# EAGLE schematic Resistor_Resistor (EAGLE 8.3.0), part 29 of 43
## Nets (continued)
N$2: R201.2 R202.2 R203.2 R204.2 R205.2 R206.2 R207.2 R208.2 R209.2 R210.2 R211.2 R212.2 R213.2 R214.2 R215.2 R216.2 R217.2 R218.2 R219.2 R220.2 R221.2 R222.2 R223.2 R224.2 R225.2 R226.2 R227.2 R228.2 R229.2 R230.2 R231.2 R232.2 R233.2 R234.2 R235.2 R236.2 R237.2 R238.2 R239.2 R240.2 R241.2 R242.2 R243.2 R244.2 R245.2 R246.2 R247.2 R248.2 R249.2 R250.2 R251.2 R252.2 R253.2 R254.2 R255.2 R256.2 R257.2 R258.2 R259.2 R260.2 R261.2 R262.2 R263.2 R264.2 R265.2 R266.2 R267.2 R268.2 R269.2 R270.2 R271.2 R272.2 R273.2 R274.2 R275.2 R276.2 R277.2 R278.2 R279.2 R280.2 R281.2 R282.2 R283.2 R284.2 R285.2 R286.2 R287.2 R288.2 R289.2 R290.2 R291.2 R292.2 R293.2 R294.2 R295.2 R296.2 R297.2 R298.2 R299.2 R300.2 R301.2 R302.2 R303.2 R304.2 R305.2 R306.2 R307.2 R308.2 R309.2 R310.2 R311.2 R312.2 R313.2 R314.2 R315.2 R316.2 R317.2 R318.2 R319.2 R320.2 R321.2 R322.2 R323.2 R324.2 R325.2 R326.2 R327.2 R328.2 R329.2 R330.2 R331.2 R332.2 R333.2 R334.2 R335.2 R336.2 R337.2 R338.2 R339.2 R340.2 R341.2 R342.2 R343.2 R344.2 R345.2 R346.2 R347.2 R348.2 R349.2 R350.2 R351.2 R352.2 R353.2 R354.2 R355.2 R356.2 R357.2 R358.2 R359.2 R360.2 R361.2 R362.2 R363.2 R364.2 R365.2 R366.2 R367.2 R368.2 R369.2 R370.2 R371.2 R372.2 R373.2 R374.2 R375.2 R376.2 R377.2 R378.2 R379.2 R380.2 R381.2 R382.2 R383.2 R384.2 R385.2 R386.2 R387.2 R388.2 R389.2 R390.2 R391.2 R392.2 R393.2 R394.2 R395.2 R396.2 R397.2 R398.2 R399.2 R400.2 R401.1 R402.1 R403.1 R404.1 R405.1 R406.1 R407.1 R408.1 R409.1 R410.1 R411.1 R412.1 R413.1 R414.1 R415.1 R416.1 R417.1 R418.1 R419.1 R420.1 R421.1 R422.1 R423.1 R424.1 R425.1 R426.1 R427.1 R428.1 R429.1 R430.1 R431.1 R432.1 R433.1 R434.1 R435.1 R436.1 R437.1 R438.1 R439.1 R440.1 R441.1 R442.1 R443.1 R444.1 R445.1 R446.1 R447.1 R448.1 R449.1 R450.1 R451.1 R452.1 R453.1 R454.1 R455.1 R456.1 R457.1 R458.1 R459.1 R460.1 R461.1 R462.1 R463.1 R464.1 R465.1 R466.1 R467.1 R468.1 R469.1 R470.1 R471.1 R472.1 R473.1 R474.1 R475.1 R476.1 R477.1 R478.1 R479.1 R480.1 R481.1 R482.1 R483.1 R484.1 R485.1 R486.1 R487.1 R488.1 R489.1 R490.1 R491.1 R492.1 R493.1 R494.1 R495.1 R496.1 R497.1 R498.1 R499.1 R500.1 R501.1 R502.1 R503.1 R504.1 R505.1 R506.1 R507.1 R508.1 R509.1 R510.1 R511.1 R512.1 R513.1 R514.1 R515.1 R516.1 R517.1 R518.1 R519.1 R520.1 R521.1 R522.1 R523.1 R524.1 R525.1 R526.1 R527.1 R528.1 R529.1 R530.1 R531.1 R532.1 R533.1 R534.1 R535.1 R536.1 R537.1 R538.1 R539.1 R540.1 R541.1 R542.1 R543.1 R544.1 R545.1 R546.1 R547.1 R548.1 R549.1 R550.1 R551.1 R552.1 R553.1 R554.1 R555.1 R556.1 R557.1 R558.1 R559.1 R560.1 R561.1 R562.1 R563.1 R564.1 R565.1 R566.1 R567.1 R568.1 R569.1 R570.1 R571.1 R572.1 R573.1 R574.1 R575.1 R576.1 R577.1 R578.1 R579.1 R580.1 R581.1 R582.1 R583.1 R584.1 R585.1 R586.1 R587.1 R588.1 R589.1 R590.1 R591.1 R592.1 R593.1 R594.1 R595.1 R596.1 R597.1 R598.1 R599.1 R600.1
N$4: R401.2 R402.2 R403.2 R404.2 R405.2 R406.2 R407.2 R408.2 R409.2 R410.2 R411.2 R412.2 R413.2 R414.2 R415.2 R416.2 R417.2 R418.2 R419.2 R420.2 R421.2 R422.2 R423.2 R424.2 R425.2 R426.2 R427.2 R428.2 R429.2 R430.2 R431.2 R432.2 R433.2 R434.2 R435.2 R436.2 R437.2 R438.2 R439.2 R440.2 R441.2 R442.2 R443.2 R444.2 R445.2 R446.2 R447.2 R448.2 R449.2 R450.2 R451.2 R452.2 R453.2 R454.2 R455.2 R456.2 R457.2 R458.2 R459.2 R460.2 R461.2 R462.2 R463.2 R464.2 R465.2 R466.2 R467.2 R468.2 R469.2 R470.2 R471.2 R472.2 R473.2 R474.2 R475.2 R476.2 R477.2 R478.2 R479.2 R480.2 R481.2 R482.2 R483.2 R484.2 R485.2 R486.2 R487.2 R488.2 R489.2 R490.2 R491.2 R492.2 R493.2 R494.2 R495.2 R496.2 R497.2 R498.2 R499.2 R500.2 R501.2 R502.2 R503.2 R504.2 R505.2 R506.2 R507.2 R508.2 R509.2 R510.2 R511.2 R512.2 R513.2 R514.2 R515.2 R516.2 R517.2 R518.2 R519.2 R520.2 R521.2 R522.2 R523.2 R524.2 R525.2 R526.2 R527.2 R528.2 R529.2 R530.2 R531.2 R532.2 R533.2 R534.2 R535.2 R536.2 R537.2 R538.2 R539.2 R540.2 R541.2 R542.2 R543.2 R544.2 R545.2 R546.2 R547.2 R548.2 R549.2 R550.2 R551.2 R552.2 R553.2 R554.2 R555.2 R556.2 R557.2 R558.2 R559.2 R560.2 R561.2 R562.2 R563.2 R564.2 R565.2 R566.2 R567.2 R568.2 R569.2 R570.2 R571.2 R572.2 R573.2 R574.2 R575.2 R576.2 R577.2 R578.2 R579.2 R580.2 R581.2 R582.2 R583.2 R584.2 R585.2 R586.2 R587.2 R588.2 R589.2 R590.2 R591.2 R592.2 R593.2 R594.2 R595.2 R596.2 R597.2 R598.2 R599.2 R600.2 R601.1 R602.1 R603.1 R604.1 R605.1 R606.1 R607.1 R608.1 R609.1 R610.1 R611.1 R612.1 R613.1 R614.1 R615.1 R616.1 R617.1 R618.1 R619.1 R620.1 R621.1 R622.1 R623.1 R624.1 R625.1 R626.1 R627.1 R628.1 R629.1 R630.1 R631.1 R632.1 R633.1 R634.1 R635.1 R636.1 R637.1 R638.1 R639.1 R640.1 R641.1 R642.1 R643.1 R644.1 R645.1 R646.1 R647.1 R648.1 R649.1 R650.1 R651.1 R652.1 R653.1 R654.1 R655.1 R656.1 R657.1 R658.1 R659.1 R660.1 R661.1 R662.1 R663.1 R664.1 R665.1 R666.1 R667.1 R668.1 R669.1 R670.1 R671.1 R672.1 R673.1 R674.1 R675.1 R676.1 R677.1 R678.1 R679.1 R680.1 R681.1 R682.1 R683.1 R684.1 R685.1 R686.1 R687.1 R688.1 R689.1 R690.1 R691.1 R692.1 R693.1 R694.1 R695.1 R696.1 R697.1 R698.1 R699.1 R700.1 R701.1 R702.1 R703.1 R704.1 R705.1 R706.1 R707.1 R708.1 R709.1 R710.1 R711.1 R712.1 R713.1 R714.1 R715.1 R716.1 R717.1 R718.1 R719.1 R720.1 R721.1 R722.1 R723.1 R724.1 R725.1 R726.1 R727.1 R728.1 R729.1 R730.1 R731.1 R732.1 R733.1 R734.1 R735.1 R736.1 R737.1 R738.1 R739.1 R740.1 R741.1 R742.1 R743.1 R744.1 R745.1 R746.1 R747.1 R748.1 R749.1 R750.1 R751.1 R752.1 R753.1 R754.1 R755.1 R756.1 R757.1 R758.1 R759.1 R760.1 R761.1 R762.1 R763.1 R764.1 R765.1 R766.1 R767.1 R768.1 R769.1 R770.1 R771.1 R772.1 R773.1 R774.1 R775.1 R776.1 R777.1 R778.1 R779.1 R780.1 R781.1 R782.1 R783.1 R784.1 R785.1 R786.1 R787.1 R788.1 R789.1 R790.1 R791.1 R792.1 R793.1 R794.1 R795.1 R796.1 R797.1 R798.1 R799.1 R800.1
N$5: R601.2 R602.2 R603.2 R604.2 R605.2 R606.2 R607.2 R608.2 R609.2 R610.2 R611.2 R612.2 R613.2 R614.2 R615.2 R616.2 R617.2 R618.2 R619.2 R620.2 R621.2 R622.2 R623.2 R624.2 R625.2 R626.2 R627.2 R628.2 R629.2 R630.2 R631.2 R632.2 R633.2 R634.2 R635.2 R636.2 R637.2 R638.2 R639.2 R640.2 R641.2 R642.2 R643.2 R644.2 R645.2 R646.2 R647.2 R648.2 R649.2 R650.2 R651.2 R652.2 R653.2 R654.2 R655.2 R656.2 R657.2 R658.2 R659.2 R660.2 R661.2 R662.2 R663.2 R664.2 R665.2 R666.2 R667.2 R668.2 R669.2 R670.2 R671.2 R672.2 R673.2 R674.2 R675.2 R676.2 R677.2 R678.2 R679.2 R680.2 R681.2 R682.2 R683.2 R684.2 R685.2 R686.2 R687.2 R688.2 R689.2 R690.2 R691.2 R692.2 R693.2 R694.2 R695.2 R696.2 R697.2 R698.2 R699.2 R700.2 R701.2 R702.2 R703.2 R704.2 R705.2 R706.2 R707.2 R708.2 R709.2 R710.2 R711.2 R712.2 R713.2 R714.2 R715.2 R716.2 R717.2 R718.2 R719.2 R720.2 R721.2 R722.2 R723.2 R724.2 R725.2 R726.2 R727.2 R728.2 R729.2 R730.2 R731.2 R732.2 R733.2 R734.2 R735.2 R736.2 R737.2 R738.2 R739.2 R740.2 R741.2 R742.2 R743.2 R744.2 R745.2 R746.2 R747.2 R748.2 R749.2 R750.2 R751.2 R752.2 R753.2 R754.2 R755.2 R756.2 R757.2 R758.2 R759.2 R760.2 R761.2 R762.2 R763.2 R764.2 R765.2 R766.2 R767.2 R768.2 R769.2 R770.2 R771.2 R772.2 R773.2 R774.2 R775.2 R776.2 R777.2 R778.2 R779.2 R780.2 R781.2 R782.2 R783.2 R784.2 R785.2 R786.2 R787.2 R788.2 R789.2 R790.2 R791.2 R792.2 R793.2 R794.2 R795.2 R796.2 R797.2 R798.2 R799.2 R800.2 R801.1 R802.1 R803.1 R804.1 R805.1 R806.1 R807.1 R808.1 R809.1 R810.1 R811.1 R812.1 R813.1 R814.1 R815.1 R816.1 R817.1 R818.1 R819.1 R820.1 R821.1 R822.1 R823.1 R824.1 R825.1 R826.1 R827.1 R828.1 R829.1 R830.1 R831.1 R832.1 R833.1 R834.1 R835.1 R836.1 R837.1 R838.1 R839.1 R840.1 R841.1 R842.1 R843.1 R844.1 R845.1 R846.1 R847.1 R848.1 R849.1 R850.1 R851.1 R852.1 R853.1 R854.1 R855.1 R856.1 R857.1 R858.1 R859.1 R860.1 R861.1 R862.1 R863.1 R864.1 R865.1 R866.1 R867.1 R868.1 R869.1 R870.1 R871.1 R872.1 R873.1 R874.1 R875.1 R876.1 R877.1 R878.1 R879.1 R880.1 R881.1 R882.1 R883.1 R884.1 R885.1 R886.1 R887.1 R888.1 R889.1 R890.1 R891.1 R892.1 R893.1 R894.1 R895.1 R896.1 R897.1 R898.1 R899.1 R900.1 R901.1 R902.1 R903.1 R904.1 R905.1 R906.1 R907.1 R908.1 R909.1 R910.1 R911.1 R912.1 R913.1 R914.1 R915.1 R916.1 R917.1 R918.1 R919.1 R920.1 R921.1 R922.1 R923.1 R924.1 R925.1 R926.1 R927.1 R928.1 R929.1 R930.1 R931.1 R932.1 R933.1 R934.1 R935.1 R936.1 R937.1 R938.1 R939.1 R940.1 R941.1 R942.1 R943.1 R944.1 R945.1 R946.1 R947.1 R948.1 R949.1 R950.1 R951.1 R952.1 R953.1 R954.1 R955.1 R956.1 R957.1 R958.1 R959.1 R960.1 R961.1 R962.1 R963.1 R964.1 R965.1 R966.1 R967.1 R968.1 R969.1 R970.1 R971.1 R972.1 R973.1 R974.1 R975.1 R976.1 R977.1 R978.1 R979.1 R980.1 R981.1 R982.1 R983.1 R984.1 R985.1 R986.1 R987.1 R988.1 R989.1 R990.1 R991.1 R992.1 R993.1 R994.1 R995.1 R996.1 R997.1 R998.1 R999.1 R1000.1
N$7: R1.1 R2.1 R3.1 R4.1 R5.1 R6.1 R7.1 R8.1 R9.1 R10.1 R11.1 R12.1 R13.1 R14.1 R15.1 R16.1 R17.1 R18.1 R19.1 R20.1 R21.1 R22.1 R23.1 R24.1 R25.1 R26.1 R27.1 R28.1 R29.1 R30.1 R31.1 R32.1 R33.1 R34.1 R35.1 R36.1 R37.1 R38.1 R39.1 R40.1 R41.1 R42.1 R43.1 R44.1 R45.1 R46.1 R47.1 R48.1 R49.1 R50.1 R51.1 R52.1 R53.1 R54.1 R55.1 R56.1 R57.1 R58.1 R59.1 R60.1 R61.1 R62.1 R63.1 R64.1 R65.1 R66.1 R67.1 R68.1 R69.1 R70.1 R71.1 R72.1 R73.1 R74.1 R75.1 R76.1 R77.1 R78.1 R79.1 R80.1 R81.1 R82.1 R83.1 R84.1 R85.1 R86.1 R87.1 R88.1 R89.1 R90.1 R91.1 R92.1 R93.1 R94.1 R95.1 R96.1 R97.1 R98.1 R99.1 R100.1 R101.1 R102.1 R103.1 R104.1 R105.1 R106.1 R107.1 R108.1 R109.1 R110.1 R111.1 R112.1 R113.1 R114.1 R115.1 R116.1 R117.1 R118.1 R119.1 R120.1 R121.1 R122.1 R123.1 R124.1 R125.1 R126.1 R127.1 R128.1 R129.1 R130.1 R131.1 R132.1 R133.1 R134.1 R135.1 R136.1 R137.1 R138.1 R139.1 R140.1 R141.1 R142.1 R143.1 R144.1 R145.1 R146.1 R147.1 R148.1 R149.1 R150.1 R151.1 R152.1 R153.1 R154.1 R155.1 R156.1 R157.1 R158.1 R159.1 R160.1 R161.1 R162.1 R163.1 R164.1 R165.1 R166.1 R167.1 R168.1 R169.1 R170.1 R171.1 R172.1 R173.1 R174.1 R175.1 R176.1 R177.1 R178.1 R179.1 R180.1 R181.1 R182.1 R183.1 R184.1 R185.1 R186.1 R187.1 R188.1 R189.1 R190.1 R191.1 R192.1 R193.1 R194.1 R195.1 R196.1 R197.1 R198.1 R199.1 R200.1
N$8: R1.2 R2.2 R3.2 R4.2 R5.2 R6.2 R7.2 R8.2 R9.2 R10.2 R11.2 R12.2 R13.2 R14.2 R15.2 R16.2 R17.2 R18.2 R19.2 R20.2 R21.2 R22.2 R23.2 R24.2 R25.2 R26.2 R27.2 R28.2 R29.2 R30.2 R31.2 R32.2 R33.2 R34.2 R35.2 R36.2 R37.2 R38.2 R39.2 R40.2 R41.2 R42.2 R43.2 R44.2 R45.2 R46.2 R47.2 R48.2 R49.2 R50.2 R51.2 R52.2 R53.2 R54.2 R55.2 R56.2 R57.2 R58.2 R59.2 R60.2 R61.2 R62.2 R63.2 R64.2 R65.2 R66.2 R67.2 R68.2 R69.2 R70.2 R71.2 R72.2 R73.2 R74.2 R75.2 R76.2 R77.2 R78.2 R79.2 R80.2 R81.2 R82.2 R83.2 R84.2 R85.2 R86.2 R87.2 R88.2 R89.2 R90.2 R91.2 R92.2 R93.2 R94.2 R95.2 R96.2 R97.2 R98.2 R99.2 R100.2 R101.2 R102.2 R103.2 R104.2 R105.2 R106.2 R107.2 R108.2 R109.2 R110.2 R111.2 R112.2 R113.2 R114.2 R115.2 R116.2 R117.2 R118.2 R119.2 R120.2 R121.2 R122.2 R123.2 R124.2 R125.2 R126.2 R127.2 R128.2 R129.2 R130.2 R131.2 R132.2 R133.2 R134.2 R135.2 R136.2 R137.2 R138.2 R139.2 R140.2 R141.2 R142.2 R143.2 R144.2 R145.2 R146.2 R147.2 R148.2 R149.2 R150.2 R151.2 R152.2 R153.2 R154.2 R155.2 R156.2 R157.2 R158.2 R159.2 R160.2 R161.2 R162.2 R163.2 R164.2 R165.2 R166.2 R167.2 R168.2 R169.2 R170.2 R171.2 R172.2 R173.2 R174.2 R175.2 R176.2 R177.2 R178.2 R179.2 R180.2 R181.2 R182.2 R183.2 R184.2 R185.2 R186.2 R187.2 R188.2 R189.2 R190.2 R191.2 R192.2 R193.2 R194.2 R195.2 R196.2 R197.2 R198.2 R199.2 R200.2 R201.1 R202.1 R203.1 R204.1 R205.1 R206.1 R207.1 R208.1 R209.1 R210.1 R211.1 R212.1 R213.1 R214.1 R215.1 R216.1 R217.1 R218.1 R219.1 R220.1 R221.1 R222.1 R223.1 R224.1 R225.1 R226.1 R227.1 R228.1 R229.1 R230.1 R231.1 R232.1 R233.1 R234.1 R235.1 R236.1 R237.1 R238.1 R239.1 R240.1 R241.1 R242.1 R243.1 R244.1 R245.1 R246.1 R247.1 R248.1 R249.1 R250.1 R251.1 R252.1 R253.1 R254.1 R255.1 R256.1 R257.1 R258.1 R259.1 R260.1 R261.1 R262.1 R263.1 R264.1 R265.1 R266.1 R267.1 R268.1 R269.1 R270.1 R271.1 R272.1 R273.1 R274.1 R275.1 R276.1 R277.1 R278.1 R279.1 R280.1 R281.1 R282.1 R283.1 R284.1 R285.1 R286.1 R287.1 R288.1 R289.1 R290.1 R291.1 R292.1 R293.1 R294.1 R295.1 R296.1 R297.1 R298.1 R299.1 R300.1 R301.1 R302.1 R303.1 R304.1 R305.1 R306.1 R307.1 R308.1 R309.1 R310.1 R311.1 R312.1 R313.1 R314.1 R315.1 R316.1 R317.1 R318.1 R319.1 R320.1 R321.1 R322.1 R323.1 R324.1 R325.1 R326.1 R327.1 R328.1 R329.1 R330.1 R331.1 R332.1 R333.1 R334.1 R335.1 R336.1 R337.1 R338.1 R339.1 R340.1 R341.1 R342.1 R343.1 R344.1 R345.1 R346.1 R347.1 R348.1 R349.1 R350.1 R351.1 R352.1 R353.1 R354.1 R355.1 R356.1 R357.1 R358.1 R359.1 R360.1 R361.1 R362.1 R363.1 R364.1 R365.1 R366.1 R367.1 R368.1 R369.1 R370.1 R371.1 R372.1 R373.1 R374.1 R375.1 R376.1 R377.1 R378.1 R379.1 R380.1 R381.1 R382.1 R383.1 R384.1 R385.1 R386.1 R387.1 R388.1 R389.1 R390.1 R391.1 R392.1 R393.1 R394.1 R395.1 R396.1 R397.1 R398.1 R399.1 R400.1
N$9: R801.2 R802.2 R803.2 R804.2 R805.2 R806.2 R807.2 R808.2 R809.2 R810.2 R811.2 R812.2 R813.2 R814.2 R815.2 R816.2 R817.2 R818.2 R819.2 R820.2 R821.2 R822.2 R823.2 R824.2 R825.2 R826.2 R827.2 R828.2 R829.2 R830.2 R831.2 R832.2 R833.2 R834.2 R835.2 R836.2 R837.2 R838.2 R839.2 R840.2 R841.2 R842.2 R843.2 R844.2 R845.2 R846.2 R847.2 R848.2 R849.2 R850.2 R851.2 R852.2 R853.2 R854.2 R855.2 R856.2 R857.2 R858.2 R859.2 R860.2 R861.2 R862.2 R863.2 R864.2 R865.2 R866.2 R867.2 R868.2 R869.2 R870.2 R871.2 R872.2 R873.2 R874.2 R875.2 R876.2 R877.2 R878.2 R879.2 R880.2 R881.2 R882.2 R883.2 R884.2 R885.2 R886.2 R887.2 R888.2 R889.2 R890.2 R891.2 R892.2 R893.2 R894.2 R895.2 R896.2 R897.2 R898.2 R899.2 R900.2 R901.2 R902.2 R903.2 R904.2 R905.2 R906.2 R907.2 R908.2 R909.2 R910.2 R911.2 R912.2 R913.2 R914.2 R915.2 R916.2 R917.2 R918.2 R919.2 R920.2 R921.2 R922.2 R923.2 R924.2 R925.2 R926.2 R927.2 R928.2 R929.2 R930.2 R931.2 R932.2 R933.2 R934.2 R935.2 R936.2 R937.2 R938.2 R939.2 R940.2 R941.2 R942.2 R943.2 R944.2 R945.2 R946.2 R947.2 R948.2 R949.2 R950.2 R951.2 R952.2 R953.2 R954.2 R955.2 R956.2 R957.2 R958.2 R959.2 R960.2 R961.2 R962.2 R963.2 R964.2 R965.2 R966.2 R967.2 R968.2 R969.2 R970.2 R971.2 R972.2 R973.2 R974.2 R975.2 R976.2 R977.2 R978.2 R979.2 R980.2 R981.2 R982.2 R983.2 R984.2 R985.2 R986.2 R987.2 R988.2 R989.2 R990.2 R991.2 R992.2 R993.2 R994.2 R995.2 R996.2 R997.2 R998.2 R999.2 R1000.2 R1001.1 R1002.1 R1003.1 R1004.1 R1005.1 R1006.1 R1007.1 R1008.1 R1009.1 R1010.1 R1011.1 R1012.1 R1013.1 R1014.1 R1015.1 R1016.1 R1017.1 R1018.1 R1019.1 R1020.1 R1021.1 R1022.1 R1023.1 R1024.1 R1025.1 R1026.1 R1027.1 R1028.1 R1029.1 R1030.1 R1031.1 R1032.1 R1033.1 R1034.1 R1035.1 R1036.1 R1037.1 R1038.1 R1039.1 R1040.1 R1041.1 R1042.1 R1043.1 R1044.1 R1045.1 R1046.1 R1047.1 R1048.1 R1049.1 R1050.1 R1051.1 R1052.1 R1053.1 R1054.1 R1055.1 R1056.1 R1057.1 R1058.1 R1059.1 R1060.1 R1061.1 R1062.1 R1063.1 R1064.1 R1065.1 R1066.1 R1067.1 R1068.1 R1069.1 R1070.1 R1071.1 R1072.1 R1073.1 R1074.1 R1075.1 R1076.1 R1077.1 R1078.1 R1079.1 R1080.1 R1081.1 R1082.1 R1083.1 R1084.1 R1085.1 R1086.1 R1087.1 R1088.1 R1089.1 R1090.1 R1091.1 R1092.1 R1093.1 R1094.1 R1095.1 R1096.1 R1097.1 R1098.1 R1099.1 R1100.1 R1101.1 R1102.1 R1103.1 R1104.1 R1105.1 R1106.1 R1107.1 R1108.1 R1109.1 R1110.1 R1111.1 R1112.1 R1113.1 R1114.1 R1115.1 R1116.1 R1117.1 R1118.1 R1119.1 R1120.1 R1121.1 R1122.1 R1123.1 R1124.1 R1125.1 R1126.1 R1127.1 R1128.1 R1129.1 R1130.1 R1131.1 R1132.1 R1133.1 R1134.1 R1135.1 R1136.1 R1137.1 R1138.1 R1139.1 R1140.1 R1141.1 R1142.1 R1143.1 R1144.1 R1145.1 R1146.1 R1147.1 R1148.1 R1149.1 R1150.1 R1151.1 R1152.1 R1153.1 R1154.1 R1155.1 R1156.1 R1157.1 R1158.1 R1159.1 R1160.1 R1161.1 R1162.1 R1163.1 R1164.1 R1165.1 R1166.1 R1167.1 R1168.1 R1169.1 R1170.1 R1171.1 R1172.1 R1173.1 R1174.1 R1175.1 R1176.1 R1177.1 R1178.1 R1179.1 R1180.1 R1181.1 R1182.1 R1183.1 R1184.1 R1185.1 R1186.1 R1187.1 R1188.1 R1189.1 R1190.1 R1191.1 R1192.1 R1193.1 R1194.1 R1195.1 R1196.1 R1197.1 R1198.1 R1199.1 R1200.1
N$10: R1001.2 R1002.2 R1003.2 R1004.2 R1005.2 R1006.2 R1007.2 R1008.2 R1009.2 R1010.2 R1011.2 R1012.2 R1013.2 R1014.2 R1015.2 R1016.2 R1017.2 R1018.2 R1019.2 R1020.2 R1021.2 R1022.2 R1023.2 R1024.2 R1025.2 R1026.2 R1027.2 R1028.2 R1029.2 R1030.2 R1031.2 R1032.2 R1033.2 R1034.2 R1035.2 R1036.2 R1037.2 R1038.2 R1039.2 R1040.2 R1041.2 R1042.2 R1043.2 R1044.2 R1045.2 R1046.2 R1047.2 R1048.2 R1049.2 R1050.2 R1051.2 R1052.2 R1053.2 R1054.2 R1055.2 R1056.2 R1057.2 R1058.2 R1059.2 R1060.2 R1061.2 R1062.2 R1063.2 R1064.2 R1065.2 R1066.2 R1067.2 R1068.2 R1069.2 R1070.2 R1071.2 R1072.2 R1073.2 R1074.2 R1075.2 R1076.2 R1077.2 R1078.2 R1079.2 R1080.2 R1081.2 R1082.2 R1083.2 R1084.2 R1085.2 R1086.2 R1087.2 R1088.2 R1089.2 R1090.2 R1091.2 R1092.2 R1093.2 R1094.2 R1095.2 R1096.2 R1097.2 R1098.2 R1099.2 R1100.2 R1101.2 R1102.2 R1103.2 R1104.2 R1105.2 R1106.2 R1107.2 R1108.2 R1109.2 R1110.2 R1111.2 R1112.2 R1113.2 R1114.2 R1115.2 R1116.2 R1117.2 R1118.2 R1119.2 R1120.2 R1121.2 R1122.2 R1123.2 R1124.2 R1125.2 R1126.2 R1127.2 R1128.2 R1129.2 R1130.2 R1131.2 R1132.2 R1133.2 R1134.2 R1135.2 R1136.2 R1137.2 R1138.2 R1139.2 R1140.2 R1141.2 R1142.2 R1143.2 R1144.2 R1145.2 R1146.2 R1147.2 R1148.2 R1149.2 R1150.2 R1151.2 R1152.2 R1153.2 R1154.2 R1155.2 R1156.2 R1157.2 R1158.2 R1159.2 R1160.2 R1161.2 R1162.2 R1163.2 R1164.2 R1165.2 R1166.2 R1167.2 R1168.2 R1169.2 R1170.2 R1171.2 R1172.2 R1173.2 R1174.2 R1175.2 R1176.2 R1177.2 R1178.2 R1179.2 R1180.2 R1181.2 R1182.2 R1183.2 R1184.2 R1185.2 R1186.2 R1187.2 R1188.2 R1189.2 R1190.2 R1191.2 R1192.2 R1193.2 R1194.2 R1195.2 R1196.2 R1197.2 R1198.2 R1199.2 R1200.2 R1201.1 R1202.1 R1203.1 R1204.1 R1205.1 R1206.1 R1207.1 R1208.1 R1209.1 R1210.1 R1211.1 R1212.1 R1213.1 R1214.1 R1215.1 R1216.1 R1217.1 R1218.1 R1219.1 R1220.1 R1221.1 R1222.1 R1223.1 R1224.1 R1225.1 R1226.1 R1227.1 R1228.1 R1229.1 R1230.1 R1231.1 R1232.1 R1233.1 R1234.1 R1235.1 R1236.1 R1237.1 R1238.1 R1239.1 R1240.1 R1241.1 R1242.1 R1243.1 R1244.1 R1245.1 R1246.1 R1247.1 R1248.1 R1249.1 R1250.1 R1251.1 R1252.1 R1253.1 R1254.1 R1255.1 R1256.1 R1257.1 R1258.1 R1259.1 R1260.1 R1261.1 R1262.1 R1263.1 R1264.1 R1265.1 R1266.1 R1267.1 R1268.1 R1269.1 R1270.1 R1271.1 R1272.1 R1273.1 R1274.1 R1275.1 R1276.1 R1277.1 R1278.1 R1279.1 R1280.1 R1281.1 R1282.1 R1283.1 R1284.1 R1285.1 R1286.1 R1287.1 R1288.1 R1289.1 R1290.1 R1291.1 R1292.1 R1293.1 R1294.1 R1295.1 R1296.1 R1297.1 R1298.1 R1299.1 R1300.1 R1301.1 R1302.1 R1303.1 R1304.1 R1305.1 R1306.1 R1307.1 R1308.1 R1309.1 R1310.1 R1311.1 R1312.1 R1313.1 R1314.1 R1315.1 R1316.1 R1317.1 R1318.1 R1319.1 R1320.1 R1321.1 R1322.1 R1323.1 R1324.1 R1325.1 R1326.1 R1327.1 R1328.1 R1329.1 R1330.1 R1331.1 R1332.1 R1333.1 R1334.1 R1335.1 R1336.1 R1337.1 R1338.1 R1339.1 R1340.1 R1341.1 R1342.1 R1343.1 R1344.1 R1345.1 R1346.1 R1347.1 R1348.1 R1349.1 R1350.1 R1351.1 R1352.1 R1353.1 R1354.1 R1355.1 R1356.1 R1357.1 R1358.1 R1359.1 R1360.1 R1361.1 R1362.1 R1363.1 R1364.1 R1365.1 R1366.1 R1367.1 R1368.1 R1369.1 R1370.1 R1371.1 R1372.1 R1373.1 R1374.1 R1375.1 R1376.1 R1377.1 R1378.1 R1379.1 R1380.1 R1381.1 R1382.1 R1383.1 R1384.1 R1385.1 R1386.1 R1387.1 R1388.1 R1389.1 R1390.1 R1391.1 R1392.1 R1393.1 R1394.1 R1395.1 R1396.1 R1397.1 R1398.1 R1399.1 R1400.1
N$11: R1201.2 R1202.2 R1203.2 R1204.2 R1205.2 R1206.2 R1207.2 R1208.2 R1209.2 R1210.2 R1211.2 R1212.2 R1213.2 R1214.2 R1215.2 R1216.2 R1217.2 R1218.2 R1219.2 R1220.2 R1221.2 R1222.2 R1223.2 R1224.2 R1225.2 R1226.2 R1227.2 R1228.2 R1229.2 R1230.2 R1231.2 R1232.2 R1233.2 R1234.2 R1235.2 R1236.2 R1237.2 R1238.2 R1239.2 R1240.2 R1241.2 R1242.2 R1243.2 R1244.2 R1245.2 R1246.2 R1247.2 R1248.2 R1249.2 R1250.2 R1251.2 R1252.2 R1253.2 R1254.2 R1255.2 R1256.2 R1257.2 R1258.2 R1259.2 R1260.2 R1261.2 R1262.2 R1263.2 R1264.2 R1265.2 R1266.2 R1267.2 R1268.2 R1269.2 R1270.2 R1271.2 R1272.2 R1273.2 R1274.2 R1275.2 R1276.2 R1277.2 R1278.2 R1279.2 R1280.2 R1281.2 R1282.2 R1283.2 R1284.2 R1285.2 R1286.2 R1287.2 R1288.2 R1289.2 R1290.2 R1291.2 R1292.2 R1293.2 R1294.2 R1295.2 R1296.2 R1297.2 R1298.2 R1299.2 R1300.2 R1301.2 R1302.2 R1303.2 R1304.2 R1305.2 R1306.2 R1307.2 R1308.2 R1309.2 R1310.2 R1311.2 R1312.2 R1313.2 R1314.2 R1315.2 R1316.2 R1317.2 R1318.2 R1319.2 R1320.2 R1321.2 R1322.2 R1323.2 R1324.2 R1325.2 R1326.2 R1327.2 R1328.2 R1329.2 R1330.2 R1331.2 R1332.2 R1333.2 R1334.2 R1335.2 R1336.2 R1337.2 R1338.2 R1339.2 R1340.2 R1341.2 R1342.2 R1343.2 R1344.2 R1345.2 R1346.2 R1347.2 R1348.2 R1349.2 R1350.2 R1351.2 R1352.2 R1353.2 R1354.2 R1355.2 R1356.2 R1357.2 R1358.2 R1359.2 R1360.2 R1361.2 R1362.2 R1363.2 R1364.2 R1365.2 R1366.2 R1367.2 R1368.2 R1369.2 R1370.2 R1371.2 R1372.2 R1373.2 R1374.2 R1375.2 R1376.2 R1377.2 R1378.2 R1379.2 R1380.2 R1381.2 R1382.2 R1383.2 R1384.2 R1385.2 R1386.2 R1387.2 R1388.2 R1389.2 R1390.2 R1391.2 R1392.2 R1393.2 R1394.2 R1395.2 R1396.2 R1397.2 R1398.2 R1399.2 R1400.2 R1401.1 R1402.1 R1403.1 R1404.1 R1405.1 R1406.1 R1407.1 R1408.1 R1409.1 R1410.1 R1411.1 R1412.1 R1413.1 R1414.1 R1415.1 R1416.1 R1417.1 R1418.1 R1419.1 R1420.1 R1421.1 R1422.1 R1423.1 R1424.1 R1425.1 R1426.1 R1427.1 R1428.1 R1429.1 R1430.1 R1431.1 R1432.1 R1433.1 R1434.1 R1435.1 R1436.1 R1437.1 R1438.1 R1439.1 R1440.1 R1441.1 R1442.1 R1443.1 R1444.1 R1445.1 R1446.1 R1447.1 R1448.1 R1449.1 R1450.1 R1451.1 R1452.1 R1453.1 R1454.1 R1455.1 R1456.1 R1457.1 R1458.1 R1459.1 R1460.1 R1461.1 R1462.1 R1463.1 R1464.1 R1465.1 R1466.1 R1467.1 R1468.1 R1469.1 R1470.1 R1471.1 R1472.1 R1473.1 R1474.1 R1475.1 R1476.1 R1477.1 R1478.1 R1479.1 R1480.1 R1481.1 R1482.1 R1483.1 R1484.1 R1485.1 R1486.1 R1487.1 R1488.1 R1489.1 R1490.1 R1491.1 R1492.1 R1493.1 R1494.1 R1495.1 R1496.1 R1497.1 R1498.1 R1499.1 R1500.1 R1501.1 R1502.1 R1503.1 R1504.1 R1505.1 R1506.1 R1507.1 R1508.1 R1509.1 R1510.1 R1511.1 R1512.1 R1513.1 R1514.1 R1515.1 R1516.1 R1517.1 R1518.1 R1519.1 R1520.1 R1521.1 R1522.1 R1523.1 R1524.1 R1525.1 R1526.1 R1527.1 R1528.1 R1529.1 R1530.1 R1531.1 R1532.1 R1533.1 R1534.1 R1535.1 R1536.1 R1537.1 R1538.1 R1539.1 R1540.1 R1541.1 R1542.1 R1543.1 R1544.1 R1545.1 R1546.1 R1547.1 R1548.1 R1549.1 R1550.1 R1551.1 R1552.1 R1553.1 R1554.1 R1555.1 R1556.1 R1557.1 R1558.1 R1559.1 R1560.1 R1561.1 R1562.1 R1563.1 R1564.1 R1565.1 R1566.1 R1567.1 R1568.1 R1569.1 R1570.1 R1571.1 R1572.1 R1573.1 R1574.1 R1575.1 R1576.1 R1577.1 R1578.1 R1579.1 R1580.1 R1581.1 R1582.1 R1583.1 R1584.1 R1585.1 R1586.1 R1587.1 R1588.1 R1589.1 R1590.1 R1591.1 R1592.1 R1593.1 R1594.1 R1595.1 R1596.1 R1597.1 R1598.1 R1599.1 R1600.1
N$12: R1401.2 R1402.2 R1403.2 R1404.2 R1405.2 R1406.2 R1407.2 R1408.2 R1409.2 R1410.2 R1411.2 R1412.2 R1413.2 R1414.2 R1415.2 R1416.2 R1417.2 R1418.2 R1419.2 R1420.2 R1421.2 R1422.2 R1423.2 R1424.2 R1425.2 R1426.2 R1427.2 R1428.2 R1429.2 R1430.2 R1431.2 R1432.2 R1433.2 R1434.2 R1435.2 R1436.2 R1437.2 R1438.2 R1439.2 R1440.2 R1441.2 R1442.2 R1443.2 R1444.2 R1445.2 R1446.2 R1447.2 R1448.2 R1449.2 R1450.2 R1451.2 R1452.2 R1453.2 R1454.2 R1455.2 R1456.2 R1457.2 R1458.2 R1459.2 R1460.2 R1461.2 R1462.2 R1463.2 R1464.2 R1465.2 R1466.2 R1467.2 R1468.2 R1469.2 R1470.2 R1471.2 R1472.2 R1473.2 R1474.2 R1475.2 R1476.2 R1477.2 R1478.2 R1479.2 R1480.2 R1481.2 R1482.2 R1483.2 R1484.2 R1485.2 R1486.2 R1487.2 R1488.2 R1489.2 R1490.2 R1491.2 R1492.2 R1493.2 R1494.2 R1495.2 R1496.2 R1497.2 R1498.2 R1499.2 R1500.2 R1501.2 R1502.2 R1503.2 R1504.2 R1505.2 R1506.2 R1507.2 R1508.2 R1509.2 R1510.2 R1511.2 R1512.2 R1513.2 R1514.2 R1515.2 R1516.2 R1517.2 R1518.2 R1519.2 R1520.2 R1521.2 R1522.2 R1523.2 R1524.2 R1525.2 R1526.2 R1527.2 R1528.2 R1529.2 R1530.2 R1531.2 R1532.2 R1533.2 R1534.2 R1535.2 R1536.2 R1537.2 R1538.2 R1539.2 R1540.2 R1541.2 R1542.2 R1543.2 R1544.2 R1545.2 R1546.2 R1547.2 R1548.2 R1549.2 R1550.2 R1551.2 R1552.2 R1553.2 R1554.2 R1555.2 R1556.2 R1557.2 R1558.2 R1559.2 R1560.2 R1561.2 R1562.2 R1563.2 R1564.2 R1565.2 R1566.2 R1567.2 R1568.2 R1569.2 R1570.2 R1571.2 R1572.2 R1573.2 R1574.2 R1575.2 R1576.2 R1577.2 R1578.2 R1579.2 R1580.2 R1581.2 R1582.2 R1583.2 R1584.2 R1585.2 R1586.2 R1587.2 R1588.2 R1589.2 R1590.2 R1591.2 R1592.2 R1593.2 R1594.2 R1595.2 R1596.2 R1597.2 R1598.2 R1599.2 R1600.2 R1601.1 R1602.1 R1603.1 R1604.1 R1605.1 R1606.1 R1607.1 R1608.1 R1609.1 R1610.1 R1611.1 R1612.1 R1613.1 R1614.1 R1615.1 R1616.1 R1617.1 R1618.1 R1619.1 R1620.1 R1621.1 R1622.1 R1623.1 R1624.1 R1625.1 R1626.1 R1627.1 R1628.1 R1629.1 R1630.1 R1631.1 R1632.1 R1633.1 R1634.1 R1635.1 R1636.1 R1637.1 R1638.1 R1639.1 R1640.1 R1641.1 R1642.1 R1643.1 R1644.1 R1645.1 R1646.1 R1647.1 R1648.1 R1649.1 R1650.1 R1651.1 R1652.1 R1653.1 R1654.1 R1655.1 R1656.1 R1657.1 R1658.1 R1659.1 R1660.1 R1661.1 R1662.1 R1663.1 R1664.1 R1665.1 R1666.1 R1667.1 R1668.1 R1669.1 R1670.1 R1671.1 R1672.1 R1673.1 R1674.1 R1675.1 R1676.1 R1677.1 R1678.1 R1679.1 R1680.1 R1681.1 R1682.1 R1683.1 R1684.1 R1685.1 R1686.1 R1687.1 R1688.1 R1689.1 R1690.1 R1691.1 R1692.1 R1693.1 R1694.1 R1695.1 R1696.1 R1697.1 R1698.1 R1699.1 R1700.1 R1701.1 R1702.1 R1703.1 R1704.1 R1705.1 R1706.1 R1707.1 R1708.1 R1709.1 R1710.1 R1711.1 R1712.1 R1713.1 R1714.1 R1715.1 R1716.1 R1717.1 R1718.1 R1719.1 R1720.1 R1721.1 R1722.1 R1723.1 R1724.1 R1725.1 R1726.1 R1727.1 R1728.1 R1729.1 R1730.1 R1731.1 R1732.1 R1733.1 R1734.1 R1735.1 R1736.1 R1737.1 R1738.1 R1739.1 R1740.1 R1741.1 R1742.1 R1743.1 R1744.1 R1745.1 R1746.1 R1747.1 R1748.1 R1749.1 R1750.1 R1751.1 R1752.1 R1753.1 R1754.1 R1755.1 R1756.1 R1757.1 R1758.1 R1759.1 R1760.1 R1761.1 R1762.1 R1763.1 R1764.1 R1765.1 R1766.1 R1767.1 R1768.1 R1769.1 R1770.1 R1771.1 R1772.1 R1773.1 R1774.1 R1775.1 R1776.1 R1777.1 R1778.1 R1779.1 R1780.1 R1781.1 R1782.1 R1783.1 R1784.1 R1785.1 R1786.1 R1787.1 R1788.1 R1789.1 R1790.1 R1791.1 R1792.1 R1793.1 R1794.1 R1795.1 R1796.1 R1797.1 R1798.1 R1799.1 R1800.1